# EasyEDA Pro project Foc驱动板.eprj, schematic Schematic1
Board Name: Board1; Create Date: 2026-01-11; Page Name: P1; Project Name: Foc驱动板; Schematic Name: Schematic1; Update Date: 2026-01-12; Company: 嘉立创EDA; Page Size: A4; Version: V1.0
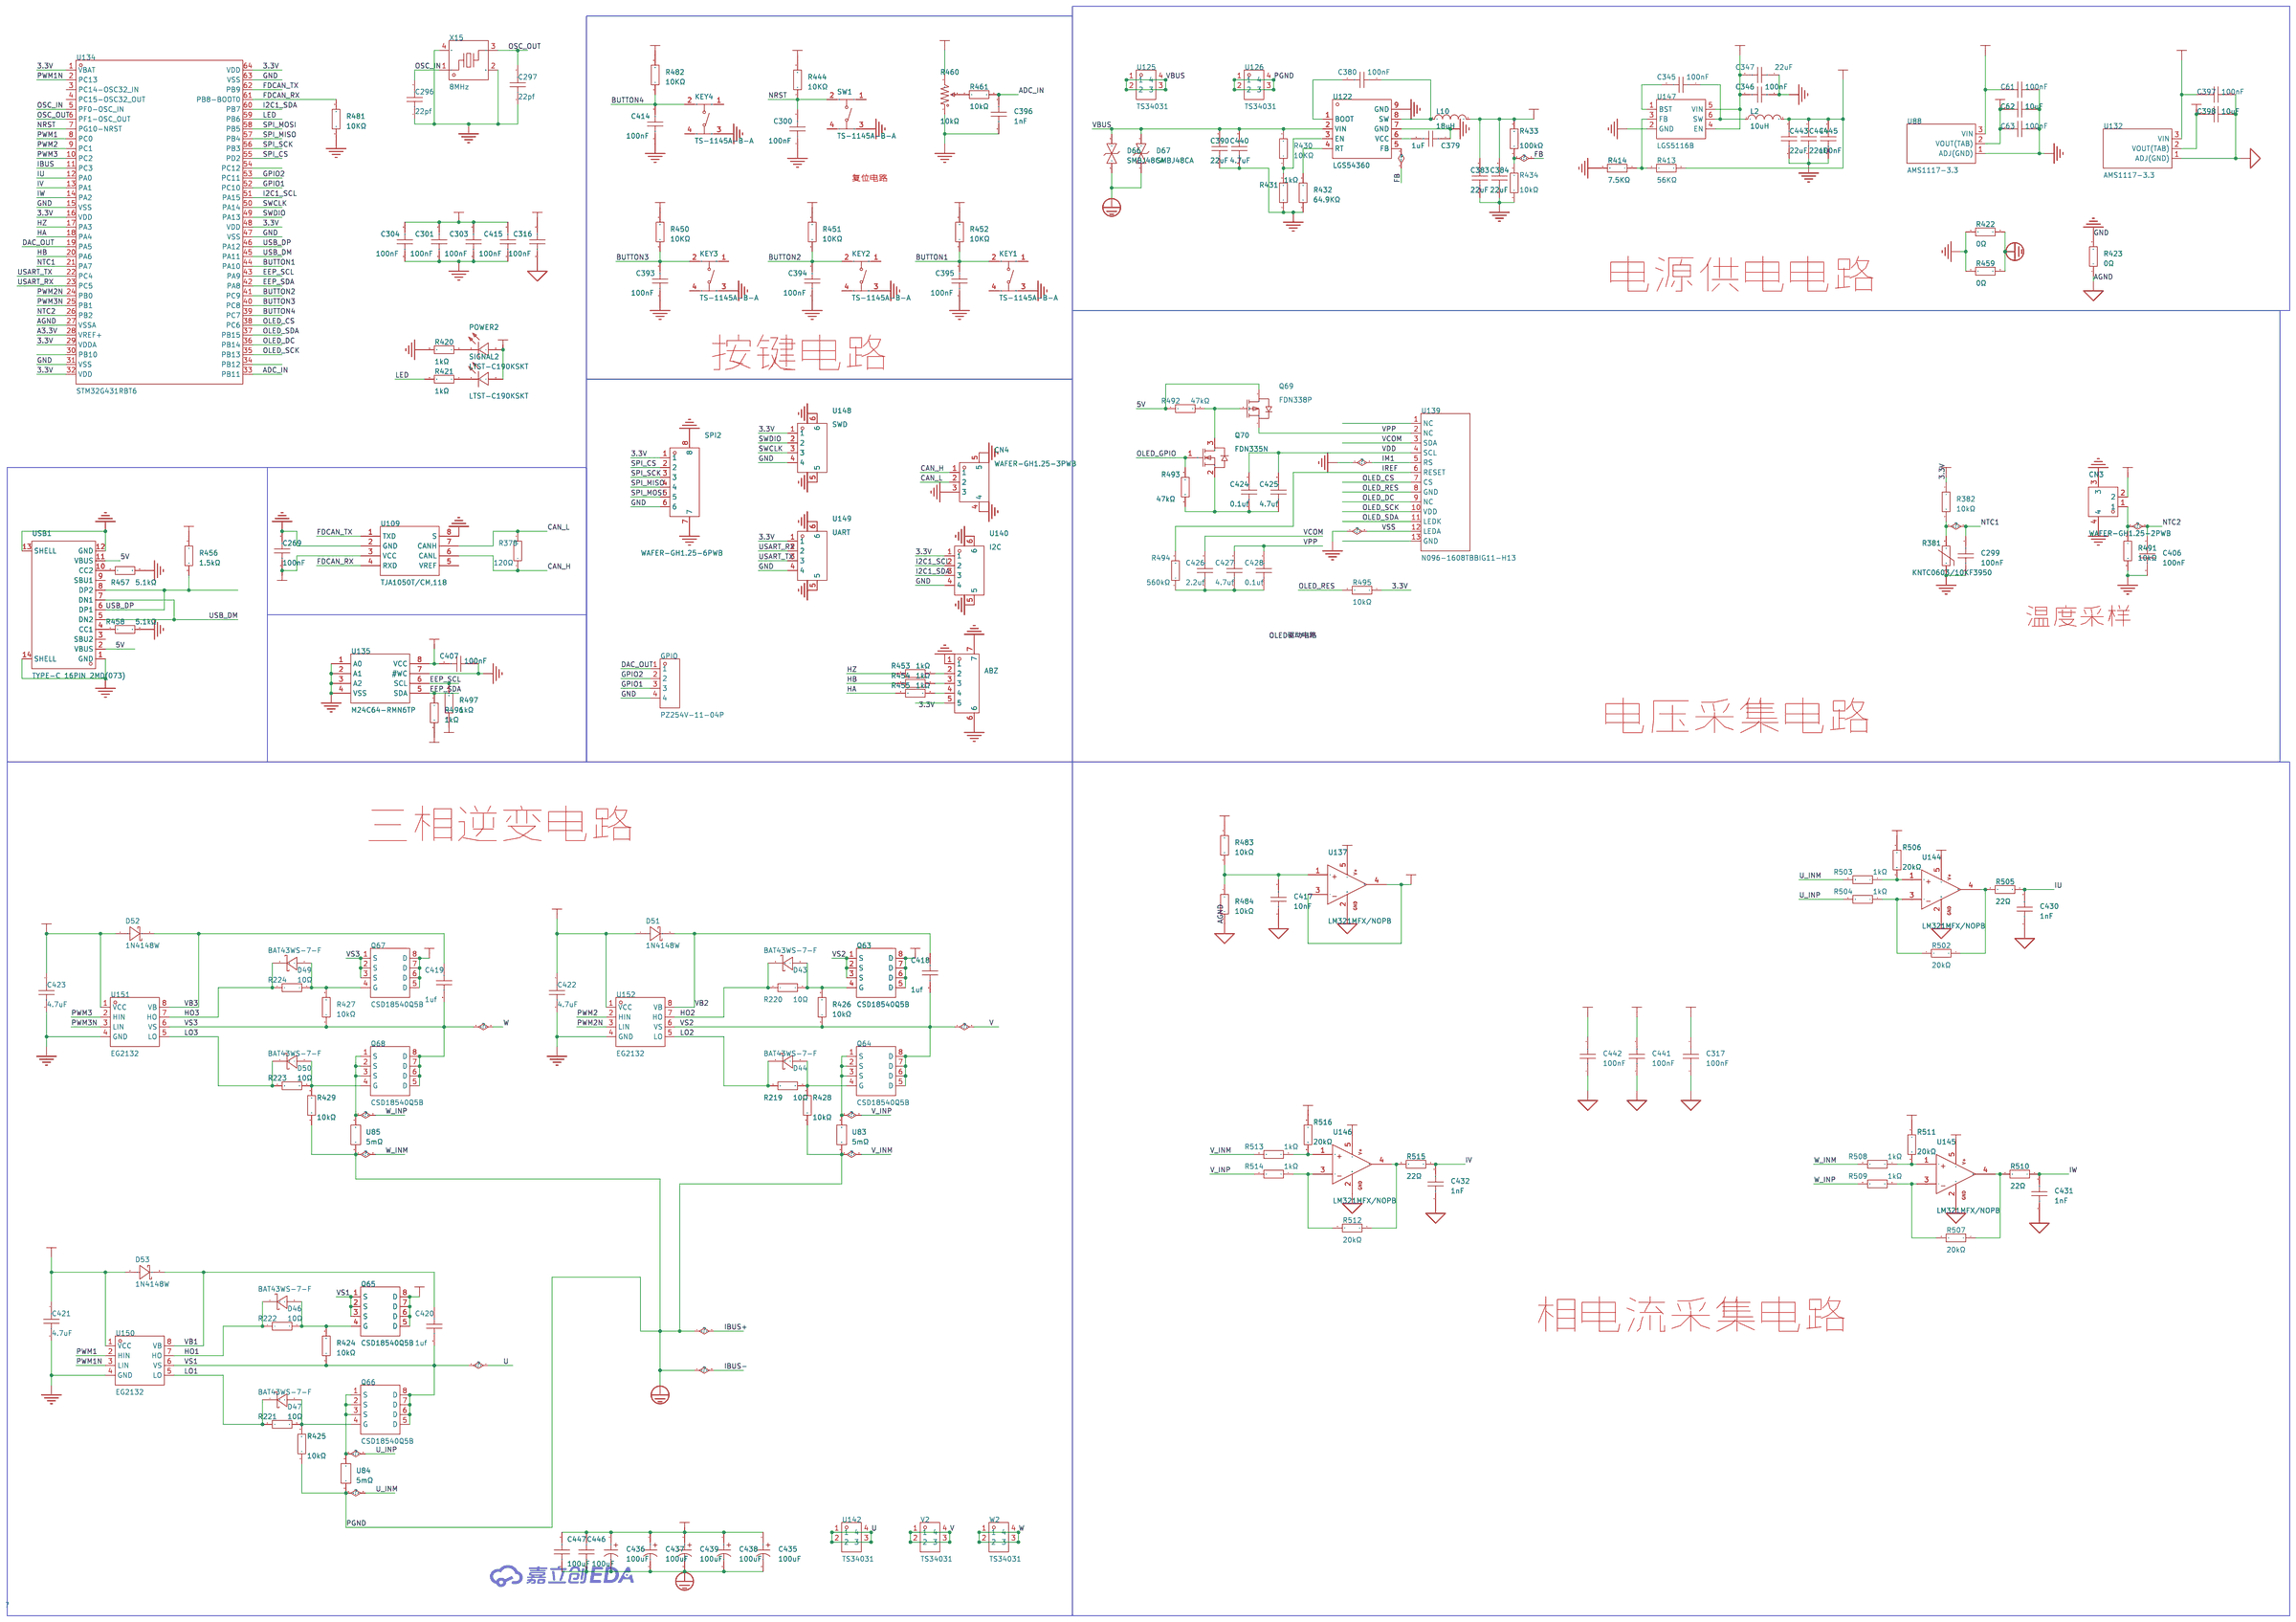
[diagram p0: schematic sheet]

## Parts
C61  100nF  [C0603]
C62  10uF  [C0603]
C63  100nF  [C0603]
C269  100nF  [C0603]
C296  22pf  [C0603]
C297  22pf  [C0603]
C299  100nF  [C0603]
C300  100nF  [C0603]
C301  100nF  [C0603]
C303  100nF  [C0603]
C304  100nF  [C0603]
C316  100nF  [C0603]
C317  100nF  [C0603]
C345  100nF  [C0603]
C346  100nF  [C0603]
C347  22uF  [C0603]
C379  1uF  [C0603]
C380  100nF  [C0603]
C383  22uF  [C0805]
C384  22uF  [C0805]
C390  22uF  [C0805]
C393  100nF  [C0603]
C394  100nF  [C0603]
C395  100nF  [C0603]
C396  1nF  [C0603]
C397  100nF  [C0603]
C398  10uF  [C0603]
C406  100nF  [C0603]
C407  100nF  [C0603]
C414  100nF  [C0603]
C415  100nF  [C0603]
C417  10nF  [C0603]
C418  1uf  [C0603]
C419  1uf  [C0603]
C420  1uf  [C0603]
C421  4.7uF  [C0603]
C422  4.7uF  [C0603]
C423  4.7uF  [C0603]
C424  0.1uf  [C0603]
C425  4.7uf  [C0603]
C426  2.2uf  [C0603]
C427  4.7uf  [C0603]
C428  0.1uf  [C0603]
C430  1nF  [C0603]
C431  1nF  [C0603]
C432  1nF  [C0603]
C435  100uF  [CAP-TH_BD8.0-P3.50-D0.5-FD]
C436  100uF  [CAP-TH_BD8.0-P3.50-D0.5-FD]
C437  100uF  [CAP-TH_BD8.0-P3.50-D0.5-FD]
C438  100uF  [CAP-TH_BD8.0-P3.50-D0.5-FD]
C439  100uF  [CAP-TH_BD8.0-P3.50-D0.5-FD]
C440  4.7uF  [C0805]
C441  100nF  [C0603]
C442  100nF  [C0603]
C443  22uF  [C0603]
C444  22uF  [C0603]
C445  100nF  [C0603]
C446  100uF  [C1210]
C447  100uF  [C1210]
CN3  WAFER-GH1.25-2PWB  [CONN-TH_2P-P1.25_XUNPU_WAFER-GH1.25-2PWB]
CN4  WAFER-GH1.25-3PWB  [CONN-TH_3P-P1.25_GH1.25]
D43  BAT43WS-7-F  [SOD-323_L1.8-W1.3-LS2.5-RD]
D44  BAT43WS-7-F  [SOD-323_L1.8-W1.3-LS2.5-RD]
D46  BAT43WS-7-F  [SOD-323_L1.8-W1.3-LS2.5-RD]
D47  BAT43WS-7-F  [SOD-323_L1.8-W1.3-LS2.5-RD]
D49  BAT43WS-7-F  [SOD-323_L1.8-W1.3-LS2.5-RD]
D50  BAT43WS-7-F  [SOD-323_L1.8-W1.3-LS2.5-RD]
D51  1N4148W  [SOD-123_L2.7-W1.6-LS3.7-FD]
D52  1N4148W  [SOD-123_L2.7-W1.6-LS3.7-FD]
D53  1N4148W  [SOD-123_L2.7-W1.6-LS3.7-FD]
D66  SMBJ48CA  [SMB_L4.6-W3.6-LS5.4-BI]
D67  SMBJ48CA  [SMB_L4.6-W3.6-LS5.4-BI]
GPIO  PZ254V-11-04P  [HDR-TH_4P-P2.54-V-M]
HALL2  ABZ  [CONN-SMD_5P-P1.25_XUNPU_WAFER-GH1.25-5PWB]
KEY1  TS-1145A-B-A  [SW-SMD_4P-L4.2-W3.2-P2.15-LS5.2]
KEY2  TS-1145A-B-A  [SW-SMD_4P-L4.2-W3.2-P2.15-LS5.2]
KEY3  TS-1145A-B-A  [SW-SMD_4P-L4.2-W3.2-P2.15-LS5.2]
KEY4  TS-1145A-B-A  [SW-SMD_4P-L4.2-W3.2-P2.15-LS5.2]
L2  10uH  [IND-SMD_L5.4-W5.2_FXL0530]
L10  18uH  [IND-SMD_L6.0-W6.0]
POWER2  LTST-C190KSKT  [LED0603-RD]
Q63  CSD18540Q5B  [VSON-CLIP-8_L5.0-W6.0-P1.27-BL]
Q64  CSD18540Q5B  [VSON-CLIP-8_L5.0-W6.0-P1.27-BL]
Q65  CSD18540Q5B  [VSON-CLIP-8_L5.0-W6.0-P1.27-BL]
Q66  CSD18540Q5B  [VSON-CLIP-8_L5.0-W6.0-P1.27-BL]
Q67  CSD18540Q5B  [VSON-CLIP-8_L5.0-W6.0-P1.27-BL]
Q68  CSD18540Q5B  [VSON-CLIP-8_L5.0-W6.0-P1.27-BL]
Q69  FDN338P  [SOT-23-3_L2.9-W1.3-P1.90-LS2.4-BR]
Q70  FDN335N  [SOT-23-3_L3.0-W1.7-P0.95-LS2.9-BR]
R219  10Ω  [R0603]
R220  10Ω  [R0603]
R221  10Ω  [R0603]
R222  10Ω  [R0603]
R223  10Ω  [R0603]
R224  10Ω  [R0603]
R378  120Ω  [R0603]
R381  KNTC0603/10KF3950  [R0603]
R382  10kΩ  [R0603]
R413  56KΩ  [R0603]
R414  7.5KΩ  [R0603]
R420  1kΩ  [R0603]
R421  1kΩ  [R0603]
R422  0Ω  [R0805]
R423  0Ω  [R0805]
R424  10kΩ  [R0603]
R425  10kΩ  [R0603]
R426  10kΩ  [R0603]
R427  10kΩ  [R0603]
R428  10kΩ  [R0603]
R429  10kΩ  [R0603]
R430  10KΩ  [R0603]
R431  1kΩ  [R0603]
R432  64.9KΩ  [R0603]
R433  100kΩ  [R0603]
R434  10kΩ  [R0603]
R444  10KΩ  [R0603]
R450  10KΩ  [R0603]
R451  10KΩ  [R0603]
R452  10KΩ  [R0603]
R453  1kΩ  [R0603]
R454  1kΩ  [R0603]
R455  1kΩ  [R0603]
R456  1.5kΩ  [R0603]
R457  5.1kΩ  [R0603]
R458  5.1kΩ  [R0603]
R459  0Ω  [R0805]
R460  10kΩ  [RES-ADJ-TH_3P-L9.5-W9.5-P2.54-BR-BS]
R461  10kΩ  [R0603]
R481  10KΩ  [R0603]
R482  10KΩ  [R0603]
R483  10kΩ  [R0603]
R484  10kΩ  [R0603]
R491  10kΩ  [R0603]
R492  47kΩ  [R0603]
R493  47kΩ  [R0603]
R494  560kΩ  [R0603]
R495  10kΩ  [R0603]
R496  1kΩ  [R0603]
R497  1kΩ  [R0603]
R502  20kΩ  [R0603]
R503  1kΩ  [R0603]
R504  1kΩ  [R0603]
R505  22Ω  [R0603]
R506  20kΩ  [R0603]
R507  20kΩ  [R0603]
R508  1kΩ  [R0603]
R509  1kΩ  [R0603]
R510  22Ω  [R0603]
R511  20kΩ  [R0603]
R512  20kΩ  [R0603]
R513  1kΩ  [R0603]
R514  1kΩ  [R0603]
R515  22Ω  [R0603]
R516  20kΩ  [R0603]
SIGNAL2  LTST-C190KSKT  [LED0603-RD]
SPI2  WAFER-GH1.25-6PWB  [CONN-SMD_6P-P1.25_XUNPU_WAFER-GH1.25-6PWB]
SW1  TS-1145A-B-A  [SW-SMD_4P-L4.2-W3.2-P2.15-LS5.2]
U83  5mΩ  [R2512]
U84  5mΩ  [R2512]
U85  5mΩ  [R2512]
U88  AMS1117-3.3  [SOT-89_L4.5-W2.5-P1.50-LS4.2-BR]
U109  TJA1050T/CM,118  [SOIC-8_L5.0-W4.0-P1.27-LS6.0-BL]
U122  LGS54360  [ESOP-8_L4.9-W3.9-P1.27-LS6.0-BL-EP]
U125  TS34031  [CONN-SMD_TS34031]
U126  TS34031  [CONN-SMD_TS34031]
U132  AMS1117-3.3  [SOT-89_L4.5-W2.5-P1.50-LS4.2-BR]
U134  STM32G431RBT6  [LQFP-64_L10.0-W10.0-P0.50-LS12.0-BL]
U135  M24C64-RMN6TP  [SOIC-8_L5.0-W4.0-P1.27-LS6.0-BL]
U137  LM321MFX/NOPB  [SOT-23-5_L3.0-W1.7-P0.95-LS2.8-BR]
U139  N096-1608TBBIG11-H13  [OLED-SMD_ST7735S]
U140  I2C  [CONN-SMD_4P-P1.25_XUNPU_WAFER-GH1.25-4PWB]
U142  TS34031  [CONN-SMD_TS34031]
U144  LM321MFX/NOPB  [SOT-23-5_L3.0-W1.7-P0.95-LS2.8-BR]
U145  LM321MFX/NOPB  [SOT-23-5_L3.0-W1.7-P0.95-LS2.8-BR]
U146  LM321MFX/NOPB  [SOT-23-5_L3.0-W1.7-P0.95-LS2.8-BR]
U147  LGS5116B  [SOT-23-6_L2.9-W1.6-P0.95-LS2.8-BR]
U148  SWD  [CONN-SMD_4P-P1.25_XUNPU_WAFER-GH1.25-4PWB]
U149  UART  [CONN-SMD_4P-P1.25_XUNPU_WAFER-GH1.25-4PWB]
U150  EG2132  [SOP-8_L4.9-W3.9-P1.27-LS6.0-BL]
U151  EG2132  [SOP-8_L4.9-W3.9-P1.27-LS6.0-BL]
U152  EG2132  [SOP-8_L4.9-W3.9-P1.27-LS6.0-BL]
USB1  TYPE-C 16PIN 2MD(073)  [USB-C-SMD_TYPE-C-6PIN-2MD-073]
V2  TS34031  [CONN-SMD_TS34031]
W2  TS34031  [CONN-SMD_TS34031]
X15  8MHz  [CRYSTAL-SMD_4P-L3.2-W2.5-BL]

## Library data of the parts
C61-C63 C299 C317 C396-C398 C406 C417-C428 C430-C432 C441 C442 = CGA0603X7R104K500JT: 容值:100nF;精度:±10%;额定电压:50V;材质(温度系数):X7R;; LCSC Part Name: 100nF ±10% 50V; Supplier Part: C6119867; Manufacturer: HRE(芯声); Supplier Footprint: 0603; JLCPCB Part Class: 扩展库; Supplier: LCSC; Tolerance: ±10%; Voltage Rated: 50V; Temperature Coefficient: X7R
C269 = CGA0603X5R226M160JT: 容值:22uF;精度:±20%;额定电压:16V;材质(温度系数):X5R;; LCSC Part Name: 22uF ±20% 16V; Supplier Part: C6119868; Manufacturer: HRE(芯声); Supplier Footprint: 0603; JLCPCB Part Class: 扩展库; Supplier: LCSC; Tolerance: ±20%; Voltage Rated: 16V; Temperature Coefficient: X5R
C296 C297 C300 C301 C303 C304 C316 C393-C395 C407 C414 C415 = CC0603KRX7R9BB104: 容值:100nF;精度:±10%;额定电压:50V;材质(温度系数):X7R;; LCSC Part Name: 100nF ±10% 50V; Supplier Part: C14663; Manufacturer: YAGEO(国巨); Supplier Footprint: 0603; JLCPCB Part Class: 基础库; Datasheet: https://atta.szlcsc.com/upload/public/pdf/source/20180910/C282072_33301C7F631E79921B82A8DAC6BCC5B3.pdf; Supplier: LCSC; Tolerance: ±10%; Voltage Rated: 50V; Temperature Coefficient: X7R
C345-C347 C379 C380 C443-C445 = CC0603KRX7R9BB474: 容值:470nF;精度:±10%;额定电压:50V;材质(温度系数):X7R;; LCSC Part Name: 470nF ±10% 50V; Supplier Part: C513577; Manufacturer: YAGEO(国巨); Supplier Footprint: 0603; JLCPCB Part Class: 扩展库; Datasheet: https://atta.szlcsc.com/upload/public/pdf/source/20200423/C519417_FF9998E3F66D767819CD86A66B468321.pdf; Supplier: LCSC; Tolerance: ±10%; Voltage Rated: 50V; Temperature Coefficient: X7R
C383 C384 C390 C440 = CGA0805X5R226M350MT: 容值:22uF;精度:±20%;额定电压:35V;材质(温度系数):X5R;; LCSC Part Name: 22uF ±20% 35V; Supplier Part: C6119901; Manufacturer: HRE(芯声); Supplier Footprint: 0805; JLCPCB Part Class: 扩展库; Datasheet: https://atta.szlcsc.com/upload/public/pdf/source/20231129/D589D0CC4D260F7AC3A77E53B455CCB3.pdf; Supplier: LCSC; Tolerance: ±20%; Voltage Rated: 35V; Temperature Coefficient: X5R
C435-C439 = ERG50V100M8X12: 容值:100uF;精度:±20%;额定电压:50V;纹波电流:680mA@100kHz;等效串联电阻(ESR):120mΩ@100kHz;; LCSC Part Name: 100uF ±20% 50V; Supplier Part: C47344183; Manufacturer: JIERR(捷而瑞); Supplier Footprint: 插件,D8xL12mm; JLCPCB Part Class: 扩展库; Datasheet: https://item.szlcsc.com/datasheet/ERG50V100M8X12/49556624.html; Supplier: LCSC; Tolerance: ±20%; Voltage Rating: 50V; Ripple Current: 680mA@100kHz; Equivalent Series Resistance(ESR): 120mΩ@100kHz; Pin Spacing: 3.5mm; Diameter: 8mm; Height - Seated (Max): 12mm; Lifetime: 2000hrs@105℃; Operating Temperature: -40℃~+105℃
C446 C447 = CL32B106KBJNNNE: LCSC Part Name: 10uF ±10% 50V; Supplier Part: C138687; Manufacturer: SAMSUNG(三星); Supplier Footprint: 1210; JLCPCB Part Class: 扩展库; Datasheet: https://item.szlcsc.com/datasheet/CL32B106KBJNNNE/150006.html; Supplier: LCSC; Tolerance: ±10%; Voltage Rating: 50V; Temperature Coefficient: X7R
CN3 = WAFER-GH1.25-2PWB: 插针结构:1x2P;间距:1.25mm;安装方式:卧贴;参考系列:GH;总PIN数:2P;排数:1;每排PIN数:2;行距:-;额定电流:1A;触头材质:黄铜;触头镀层:-;工作温度范围:-25℃~+85℃;; LCSC Part Name: 1x2P 间距:1.25mm 卧贴 系列:GH; Supplier Part: C3029377; Manufacturer: XUNPU(讯普); Supplier Footprint: SMD,P=1.25mm,卧贴; JLCPCB Part Class: 扩展库; Datasheet: https://atta.szlcsc.com/upload/public/pdf/source/20220527/CB8773BFB0913C3B8ABD62CB38BA101A.pdf; Supplier: LCSC; Pins Structure: 1x2P; Pitch: 1.25mm; Mounting Type: 卧贴; Reference Series: GH; Number of Pins: 2P; Number of Rows: 1; Number of PINs Per Row: 2; Current Rating: 1A; Contact Material: 黄铜; Operating Temperature: -25℃~+85℃; Voltage Rating: 125V; Plastic Material: LCP; Supplementary Features: 辅助焊脚; Color: 米色; Z-Height of the Board: 4.35mm; X-Length of Bottom Edge on Board (Spacing Line): 5.75mm; Y-Width of Bottom Edge on Board: 5mm
CN4 = WAFER-GH1.25-3PWB: LCSC Part Name: 1x3P 间距:1.25mm 卧贴 系列:GH; Supplier Part: C3029378; Manufacturer: XUNPU(讯普); Supplier Footprint: SMD,P=1.25mm,卧贴; JLCPCB Part Class: 扩展库; Datasheet: https://item.szlcsc.com/datasheet/WAFER-GH1.25-3PWB/3561390.html; Supplier: LCSC; Pins Structure: 1x3P; Pitch: 1.25mm; Mounting Type: 卧贴; Reference Series: GH; Number of Pins: 3P; Number of Rows: 1; Number of PINs Per Row: 3; Current Rating: 1A; Contact Material: 黄铜; Contact Plating: 锡; Operating Temperature: -25℃~+85℃; Voltage Rating: 125V; Plastic Material: LCP; Supplementary Features: 辅助焊脚; Color: 米色; Z-Height of the Board: 4.35mm; X-Length of Bottom Edge on Board (Spacing Line): 7mm; Y-Width of Bottom Edge on Board: 5mm
D43 D44 D46 D47 D49 D50 = BAT43WS-7-F: 正向压降(Vf):1V@0.2A;直流反向耐压(Vr):30V;整流电流:200mA;; LCSC Part Name: 电压:30V 电流:200mA; Supplier Part: C134399; Manufacturer: DIODES(美台); Supplier Footprint: SOD-323; JLCPCB Part Class: 扩展库; Datasheet: https://atta.szlcsc.com/upload/public/pdf/source/20171023/C134399_15087453364591052494.pdf; Supplier: LCSC; Forward Voltage (Vf@If): 1V@0.2A; Reverse Voltage (Vr): 30V; Rectified Current: 200mA; Reverse Leakage Current (Ir): 500nA@25V
D51-D53 = 1N4148W_C7420318: 二极管配置:独立式;正向压降(Vf):1.25V@150mA;直流反向耐压(Vr):100V;平均整流电流(Io):150mA;功率:400mW;反向恢复时间(trr):4ns;; LCSC Part Name: 电压:100V 电流:150mA; Supplier Part: C7420318; Manufacturer: 宏迦橙; Supplier Footprint: SOD-123; JLCPCB Part Class: 扩展库; Datasheet: https://atta.szlcsc.com/upload/public/pdf/source/20230828/E5C3F7A4272052930A7E03B75759BF50.pdf; Supplier: LCSC; Diode Configuration: 独立式; Forward Voltage (Vf@If): 1.25V@150mA; Reverse Voltage (Vr): 100V; Average Rectified Current (Io): 150mA; Power Dissipation: 400mW; Reverse Leakage Current: 1uA@75V; Reverse Recovery Time (trr): 4ns; Operating Temperature: -55℃~+150℃
D66 D67 = SMBJ48CA_C19077591: LCSC Part Name: 双向TVS 48V截止 峰值浪涌电流：7.75A@10/1000us; Supplier Part: C19077591; Manufacturer: R+O(宏嘉诚); Supplier Footprint: DO-214AA(SMB); JLCPCB Part Class: 扩展库; Datasheet: https://item.szlcsc.com/datasheet/SMBJ48CA/20275676.html; Supplier: LCSC; Polarity: 双向; Reverse Stand-Off Voltage (Vrwm): 48V; Clamping Voltage: 77.4V; Peak Pulse Current (Ipp): 7.75A@10/1000us; Peak Pulse Power Dissipation (Ppp): 600W@10/1000us; Voltage - Breakdown: 58.9V; Reverse Leakage Current (Ir): 5uA; Number of Channels: 单路; Operating Temperature: -55℃~+150℃; level of protection: IEC 61000-4-2; Type: TVS
GPIO = PZ254V-11-04P: 插针结构:1x4P;间距:2.54mm;行距:-;圆针/方针:方针;安装方式:直插;排数:单排;总PIN位数:4P;额定电流:3A;额定电压:250V;配合针长度:6mm;塑高:2.5mm;端接针长度:3mm;触头材质:-;工作温度:-40℃~+105℃;颜色:黑色;; LCSC Part Name: 1x4P 间距:2.54mm 方针 直插; Supplier Part: C2691448; Manufacturer: XFCN(兴飞); Supplier Footprint: 插件,P=2.54mm; JLCPCB Part Class: 扩展库; Datasheet: https://item.szlcsc.com/datasheet/PZ254V-11-04P/2801085.html; Supplier: LCSC; Pin Structure: 1x4P; Pitch: 2.54mm; Circluar Pins/Square Pins: 方针; Mounting Type: 直插; Number of Rows: 单排; Number of Pins: 4P; Current Rating: 3A; Voltage Rating (Max): 250V; Length of Mating Pin: 6mm; Insulation Height: 2.5mm; Length of End Connection Pin: 3mm; Operating Temperature: -40℃~+105℃; Color: 黑色
HALL2 = WAFER-GH1.25-5PWB: 插针结构:1x5P;间距:1.25mm;安装方式:卧贴;参考系列:GH;总PIN数:5P;排数:1;每排PIN数:5;行距:-;额定电流:1A;触头材质:黄铜;触头镀层:-;工作温度范围:-25℃~+85℃;; LCSC Part Name: 1x5P 间距:1.25mm 卧贴 系列:GH; Supplier Part: C3029380; Manufacturer: XUNPU(讯普); Supplier Footprint: SMD,P=1.25mm,卧贴; JLCPCB Part Class: 扩展库; Datasheet: https://atta.szlcsc.com/upload/public/pdf/source/20220527/CB8773BFB0913C3B8ABD62CB38BA101A.pdf; Supplier: LCSC; Pins Structure: 1x5P; Pitch: 1.25mm; Mounting Type: 卧贴; Reference Series: GH; Number of Pins: 5P; Number of Rows: 1; Number of PINs Per Row: 5; Current Rating: 1A; Contact Material: 黄铜; Operating Temperature: -25℃~+85℃; Voltage Rating: 125V; Plastic Material: LCP; Supplementary Features: 辅助焊脚; Color: 米色; Z-Height of the Board: 4.35mm; X-Length of Bottom Edge on Board (Spacing Line): 9.5mm; Y-Width of Bottom Edge on Board: 5mm
KEY1-KEY4 SW1 = TS-1145A-B-A: 电路结构:单刀单掷;按钮形状:椭圆形按钮;作用力:160gf;安装方式:立贴;开关长度:4.2mm;开关宽度:3.2mm;开关高度:2.5mm;带支架:不带;触点电流:50mA;额定电压(DC):12V;绝缘电阻:-;带灯:无;机械寿命:10万次;; LCSC Part Name: 4.2*3.2*2.5mm 立贴 轻触开关; Supplier Part: C318904; Manufacturer: XKB Connectivity(中国星坤); Supplier Footprint: SMD; JLCPCB Part Class: 扩展库; Datasheet: https://atta.szlcsc.com/upload/public/pdf/source/20211011/FC00869C3CE33BCCD344D072F551E76B.pdf; Supplier: LCSC; Circuit: 单刀单掷; Actuator Style: 椭圆形按钮; Operating Force: 160gf; Mounting Style: 立贴; Switch Length: 4.2mm; Switch Width: 3.2mm; Switch Height: 2.5mm; Strike Gundam: 不带; Contact Current: 50mA; Voltage Rating (DC): 12V; Actuator/Cap Color: 白色; With Lamp: 无; Mechanical Life: 10万次; Operating Temperature: -30℃~+85℃
L2 = FXL0530-100-M: 电感值:10uH;精度:±20%;额定电流:3.2A;饱和电流(Isat):3.5A;类型:一体成型电感;; LCSC Part Name: 10uH ±20% 3.5A; Supplier Part: C177248; Manufacturer: cjiang(长江微电); Supplier Footprint: SMD,5.2x5.4mm; JLCPCB Part Class: 扩展库; Datasheet: https://atta.szlcsc.com/upload/public/pdf/source/20240426/3189EA8206330E2108542F9E34E540E7.pdf; Supplier: LCSC; Tolerance: ±20%; Rated Current: 3.2A; Saturation Current (Isat): 3.5A; DC Resistance (DCR): 125mΩ; Type: 一体成型电感
L10 = SMNR6045-180MT: 电感值:18uH;精度:±20%;额定电流:-;饱和电流(Isat):2.3A;类型:磁胶屏蔽电感;; LCSC Part Name: 18uH ±20% 2.3A; Supplier Part: C467143; Manufacturer: SXN(顺翔诺); Supplier Footprint: SMD,6x6mm; JLCPCB Part Class: 扩展库; Datasheet: https://atta.szlcsc.com/upload/public/pdf/source/20210810/8C07D4BA256EC9B57FF3FBBF0FDAC34D.pdf; Supplier: LCSC; Tolerance: ±20%; Current - Saturation(Isat): 2.3A; DC Resistance(DCR): 106mΩ; Type: 磁胶屏蔽电感
POWER2 SIGNAL2 = LTST-C190KSKT: 发光颜色:黄色;正向电压(VF):2.1V;功率:75mW;正向电流:20mA;主波长:584.5nm~597nm;二极管配置:-;透镜颜色:无色透明透镜;色温:-;发光强度:104mcd;发光角度:130°;载带方式:-;工作温度:-30℃~+85℃;; LCSC Part Name: 黄灯; Supplier Part: C125095; Manufacturer: LITEON(光宝); Supplier Footprint: 0603; JLCPCB Part Class: Extended Part; Datasheet: https://atta.szlcsc.com/upload/public/pdf/source/20180129/C125095_15171881843821315881.pdf; Supplier: LCSC; Emitted Color: 黄色; Forward Voltage (VF): 2.1V; Power Dissipation: 75mW; Forward Current: 20mA; Dominant Wavelength: 584.5nm~597nm; Peak Wavelength: 588nm; Lens Color: 无色透明透镜; Luminous Intensity: 104mcd; Viewing Angle: 130°; Operating Temperature: -30℃~+85℃
Q63-Q68 = CSD18540Q5B: 类型:1个N沟道;漏源电压(Vdss):60V;连续漏极电流(Id):205A;导通电阻(RDS(on)@Vgs,Id):2.6mΩ@10V,28A;功率(Pd):3.8W;阈值电压(Vgs(th)@Id):1.9V@250uA;; LCSC Part Name: 1个N沟道 耐压:60V 电流:205A; Supplier Part: C86513; Manufacturer: TI(德州仪器); Supplier Footprint: VSON-8(5x6); JLCPCB Part Class: 扩展库; Datasheet: https://www.ti.com/lit/ds/symlink/csd18540q5b.pdf?ts=1718590350466&amp;ref_url=https%253A%252F%252Fwww.ti.com.cn%252Fproduct%252Fzh-cn%252FCSD18540Q5B%253FkeyMatch%253DCSD18540Q5B%2526tisearch%253Dsearch-everything%2526usecase%253DOPN; Supplier: LCSC; Type: 1个N沟道; Drain Source Voltage (Vdss): 60V; Continuous Drain Current (Id): 205A; Drain Source On Resistance (RDS(on)@Vgs,Id): 2.6mΩ@10V,28A; Power Dissipation (Pd): 3.8W; Gate Threshold Voltage (Vgs(th)@Id): 1.9V@250uA; Total Gate Charge (Qg@Vgs): 41nC@10V; Input Capacitance (Ciss@Vds): 4.23nF@30V; Reverse Transfer Capacitance (Crss@Vds): 20pF@30V; Operating Temperature: -55℃~+175℃
Q69 = FDN338P: 漏源电压(Vdss):20V;连续漏极电流(Id):1.6A;导通电阻(RDS(on)@Vgs,Id):115mΩ@4.5V,1.6A;功率(Pd):1.1W;阈值电压(Vgs(th)@Id):400mV@250uA;; LCSC Part Name: 耐压:20V 电流:1.6A; Supplier Part: C2890130; Manufacturer: TECH PUBLIC(台舟); Supplier Footprint: SOT-23; JLCPCB Part Class: 扩展库; Datasheet: https://atta.szlcsc.com/upload/public/pdf/source/20210903/7E6CB84F0F80073F6978D1021964D836.pdf; Supplier: LCSC; Drain Source Voltage (Vdss): 20V; Continuous Drain Current (Id): 1.6A; Drain Source On Resistance (RDS(on)@Vgs,Id): 115mΩ@4.5V,1.6A; Power Dissipation (Pd): 1.1W; Gate Threshold Voltage (Vgs(th)@Id): 400mV@250uA; Total Gate Charge (Qg@Vgs): 60nC@4.5V; Input Capacitance (Ciss@Vds): 405pF@10V; Reverse Transfer Capacitance (Crss@Vds): 45pF; Operating Temperature: -55℃~+150℃
Q70 = FDN335N: 类型:1个N沟道;漏源电压(Vdss):20V;连续漏极电流(Id):1.7A;导通电阻(RDS(on)@Vgs,Id):70mΩ@4.5V,1.7A;功率(Pd):500mW;阈值电压(Vgs(th)@Id):1.5V@250uA;; LCSC Part Name: 1个N沟道 耐压:20V 电流:1.7A; Supplier Part: C241804; Manufacturer: onsemi(安森美); Supplier Footprint: SOT-23-3; JLCPCB Part Class: 扩展库; Datasheet: https://atta.szlcsc.com/upload/public/pdf/source/20181106/C241804_FB6C2909C796B85F26DD1FA55F5B521F.pdf; Supplier: LCSC; Type: 1个N沟道; Drain Source Voltage (Vdss): 20V; Continuous Drain Current (Id): 1.7A; Drain Source On Resistance (RDS(on)@Vgs,Id): 70mΩ@4.5V,1.7A; Power Dissipation (Pd): 500mW; Gate Threshold Voltage (Vgs(th)@Id): 1.5V@250uA; Total Gate Charge (Qg@Vgs): 3.5nC; Input Capacitance (Ciss@Vds): 310pF@10V; Reverse Transfer Capacitance (Crss@Vds): 40pF; Operating Temperature: -55℃~+150℃
R219-R224 R378 R413 R414 R420 R421 R424-R434 R444 R450-R458 R481 R482 R492-R497 = 0603WAF1000T5E: 电阻类型:厚膜电阻;阻值:100Ω;精度:±1%;功率:100mW;最大工作电压:75V;温度系数:±200ppm/℃;; LCSC Part Name: 100Ω ±1% 100mW 厚膜电阻; Supplier Part: C22775; Manufacturer: UNI-ROYAL(厚声); Supplier Footprint: 0603; JLCPCB Part Class: 基础库; Datasheet: https://atta.szlcsc.com/upload/public/pdf/source/20200306/C422600_1E6D84923E4A46A82E41ADD87F860B5C.pdf; Supplier: LCSC; Type: 厚膜电阻; Tolerance: ±1%; Power(Watts): 100mW; Overload Voltage (Max): 75V; Temperature Coefficient: ±200ppm/℃; Operating Temperature Range: -55℃~+155℃
R381 = KNTC0603/10KF3950: 阻值:10kΩ;B值(25℃/50℃):3950K;功率:100mW;B值精度:±1%;最大稳态电流(25℃):310uA;; Supplier Part: C2892547; Manufacturer: KUU; Supplier Footprint: 0603; JLCPCB Part Class: 扩展库; Datasheet: https://atta.szlcsc.com/upload/public/pdf/source/20210908/154E92DD1F52D9B3804AA862EC2D5FAB.pdf; Supplier: LCSC; Resistance @ 25℃: 10kΩ; B Constant (25℃/50℃): 3950K; B Constant (25℃/85℃): 3987K; Power(Watts): 100mW; B Constant Tolerance: ±1%; Steady State Current (Max): 310uA; Operating Temperature: -40℃~+125℃
R382 R461 R483 R484 R491 R502-R516 = 0603WAF1002T5E: 电阻类型:厚膜电阻;阻值:10kΩ;精度:±1%;功率:100mW;最大工作电压:75V;温度系数:±100ppm/℃;; LCSC Part Name: 厚膜电阻 10kΩ ±1% 100mW; Supplier Part: C25804; Manufacturer: UNI-ROYAL(厚声); Supplier Footprint: 0603; JLCPCB Part Class: 基础库; Datasheet: https://atta.szlcsc.com/upload/public/pdf/source/20200306/C422600_1E6D84923E4A46A82E41ADD87F860B5C.pdf; Supplier: LCSC; Type: 厚膜电阻; Tolerance: ±1%; Power(Watts): 100mW; Overload Voltage (Max): 75V; Temperature Coefficient: ±100ppm/℃; Operating Temperature Range: -55℃~+155℃
R422 R423 R459 = 0805W8F0000T5E: 电阻类型:厚膜电阻;阻值:0Ω;精度:±1%;功率:125mW;最大工作电压:150V;温度系数:±800ppm/℃;; LCSC Part Name: 0Ω ±1% 125mW 厚膜电阻; Supplier Part: C17477; Manufacturer: UNI-ROYAL(厚声); Supplier Footprint: 0805; JLCPCB Part Class: 基础库; Datasheet: https://atta.szlcsc.com/upload/public/pdf/source/20200306/C422600_1E6D84923E4A46A82E41ADD87F860B5C.pdf; Supplier: LCSC; Type: 厚膜电阻; Tolerance: ±1%; Power(Watts): 125mW; Overload Voltage (Max): 150V; Temperature Coefficient: ±800ppm/℃; Operating Temperature Range: -55℃~+155℃
R460 = 3386P-1-102TLF: 阻值:1kΩ;精度:±10%;; LCSC Part Name: 1kΩ ±10%; Supplier Part: C116301; Manufacturer: BOURNS; Supplier Footprint: 插件-3P,9.5x9.5mm; JLCPCB Part Class: 扩展库; Datasheet: https://item.szlcsc.com/datasheet/3386P-1-102TLF/117554.html; Supplier: LCSC; Tolerance: ±10%
SPI2 = WAFER-GH1.25-6PWB: 插针结构:1x6P;间距:1.25mm;安装方式:卧贴;参考系列:GH;总PIN数:6P;排数:1;每排PIN数:6;行距:-;额定电流:1A;触头材质:黄铜;触头镀层:-;工作温度范围:-25℃~+85℃;; LCSC Part Name: 1x6P 间距:1.25mm 卧贴 系列:GH; Supplier Part: C3029381; Manufacturer: XUNPU(讯普); Supplier Footprint: SMD,P=1.25mm,卧贴; JLCPCB Part Class: 扩展库; Datasheet: https://atta.szlcsc.com/upload/public/pdf/source/20220527/CB8773BFB0913C3B8ABD62CB38BA101A.pdf; Supplier: LCSC; Pins Structure: 1x6P; Pitch: 1.25mm; Mounting Type: 卧贴; Reference Series: GH; Number of Pins: 6P; Number of Rows: 1; Number of PINs Per Row: 6; Current Rating: 1A; Contact Material: 黄铜; Operating Temperature: -25℃~+85℃; Voltage Rating: 125V; Plastic Material: LCP; Supplementary Features: 辅助焊脚; Color: 米色; Z-Height of the Board: 4.35mm; X-Length of Bottom Edge on Board (Spacing Line): 10.75mm; Y-Width of Bottom Edge on Board: 5mm
U83-U85 = EBWM2512FL500S9: 电阻类型:采样电阻;阻值:0.5mΩ;精度:±1%;功率:6W;温度系数:±200ppm/℃;安装方式:贴片;; LCSC Part Name: 0.5mΩ ±1% 6W; Supplier Part: C7178835; Manufacturer: RESI(开步睿思）; Supplier Footprint: 2512; JLCPCB Part Class: 扩展库; Datasheet: https://atta.szlcsc.com/upload/public/pdf/source/20231123/32E1A2B1C6B1C8175FF8915A40EC1366.pdf; Supplier: LCSC; Type: 采样电阻; Tolerance: ±1%; Power(Watts): 6W; Temperature Coefficient: ±200ppm/℃; Mounting Sytle: 贴片
U88 U132 = AMS1117-3.3_C347256: 输出类型:固定;工作电压:18V;输出电压:3.3V;输出电流:1A;电源纹波抑制比(PSRR):60dB@(120Hz);输出极性:正极;; LCSC Part Name: 输出:3.3V 电流:1A 耐压:18V; Supplier Part: C347256; Manufacturer: UMW(友台半导体); Supplier Footprint: SOT-89; JLCPCB Part Class: 扩展库; Datasheet: https://atta.szlcsc.com/upload/public/pdf/source/20241218/BAF0263FA2E44BCD8AF41AA4FA04EFAA.pdf; Supplier: LCSC; Output Type: 固定; Voltage - Supply: 18V; Output Voltage: 3.3V; Output Current: 1A; Power Supply Rejection Ratio (PSRR): 60dB@(120Hz); Voltage Dropout: 1.3V@(1A); Features: 过流保护; Output Configuration: 正极; Number of Outputs: 1
U109 = TJA1050T/CM,118: 类型:-;; LCSC Part Name: 4.75V~5.25V; Supplier Part: C6952; Manufacturer: NXP(恩智浦); Supplier Footprint: SOP-8; JLCPCB Part Class: 扩展库; Datasheet: https://www.nxp.com/docs/en/data-sheet/TJA1050.pdf; Supplier: LCSC; Supply Voltage: 4.75V~5.25V; Supply Current: 50mA
U122 = LGS54360: 功能类型:降压型;输出类型:可调;工作电压:4.2V~65V;输出电流:3A;; LCSC Part Name: 4.2V-65V输入、3A宽输出范围、低纹波的同步降压转换器; Supplier Part: C20618070; Manufacturer: Legend-Si(棱晶半导体); Supplier Footprint: ESOP-8; JLCPCB Part Class: 扩展库; Datasheet: https://atta.szlcsc.com/upload/public/pdf/source/20240202/06A4A9AFD4E8DCA649D728EB1502243D.pdf; Supplier: LCSC; Function: 降压型; Output Type: 可调; Input Voltage: 4.2V~65V; Output Current: 3A; Switching Frequency: 200kHz~2MHz; Operating Temperature: -40℃~+125℃; Synchronous Rectification: 是; Number of Outputs: 1; Topology: 降压式; Quiescent Current (Iq): 70uA; Switch tube (built-in/external): 内置
U125 U126 U142 V2 W2 = TS34031: LCSC Part Name: 四脚 M3 二件套 TS34031; Supplier Part: C481441; Manufacturer: XFCN(兴飞); Supplier Footprint: SMD; JLCPCB Part Class: 扩展库; Datasheet: https://atta.szlcsc.com/upload/public/pdf/source/20240702/F73D6C2A31E01780573F167639CEBCF1.pdf; Supplier: LCSC
U134 = STM32G431RBT6: CPU内核:ARM-M系列;CPU最大主频:170MHz;应用领域:-;; LCSC Part Name: 带DSP和FPU的170MHz主流ARM Cortex-M4 MCU，具有128 KB Flash存储器、数学加速器和中等模拟电平集成; Supplier Part: C431633; Manufacturer: ST(意法半导体); Supplier Footprint: LQFP-64(10x10); JLCPCB Part Class: 扩展库; Datasheet: https://item.szlcsc.com/datasheet/STM32G431RBT6/428111.html; Supplier: LCSC; CPU Core: ARM-M系列; CPU Maximum Speed: 170MHz; Program Storage Size: 128KB; Number of I/O: 52; ADC (Bit): 12bit; DAC (Bit): 12bit; Voltage - Supply: 1.71V~3.6V
U135 = M24C64-RMN6TP: 接口类型:I2C;存储容量:64Kbit;时钟频率(fc):1MHz;; LCSC Part Name: 64 Kbit串行I2C总线EEPROM; Supplier Part: C79988; Manufacturer: ST(意法半导体); Supplier Footprint: SOIC-8; JLCPCB Part Class: 扩展库; Datasheet: https://item.szlcsc.com/datasheet/M24C64-RMN6TP/81133.html; Supplier: LCSC; Interface: I2C; Memory Size: 64Kbit; Clock Frequency: 1MHz; Voltage - Supply: 1.8V~5.5V; Write Cycle Time(Tw): 5ms; Data Retention - TDR (Year): 200年; Write Cycle Endurance: 400万次; Operating Temperature: -40℃~+85℃
U137 U144-U146 = LM321MFX/NOPB: 放大器数:单路;轨到轨:-;增益带宽积(GBP):-;输入失调电压(Vos):7mV;压摆率(SR):400V/ms;输入偏置电流(Ib):500nA;; Supplier Part: C9405; Manufacturer: TI(德州仪器); Supplier Footprint: SOT-23-5; JLCPCB Part Class: 扩展库; Datasheet: http://www.ti.com/cn/lit/gpn/lm321; Supplier: LCSC; Number of Channels: 单路; Maximum Power Supply Range (Vdd-Vss): 32V; Vos - Input Offset Voltage: 7mV; Slew Rate: 400V/ms; Ib - Input Bias Current: 500nA; Noise density(eN): 40nV/√Hz@1kHz; Common Mode Rejection Ratio(CMRR): 85dB; Operating Temperature: -40℃~+85℃; Single supply: 3V~30V
U139 = N096-1608TBBIG11-H13: 核心芯片:ST7735S;尺寸(inch):0.96;; LCSC Part Name: 0.96寸 13PIN TFT显示模块; Supplier Part: C2890616; Manufacturer: Wisevision(新智景); JLCPCB Part Class: 扩展库; Datasheet: https://item.szlcsc.com/datasheet/N096-1608TBBIG11-H13/3115564.html; Supplier: LCSC; Controller Type: ST7735S; Size: 0.96
U140 U148 U149 = WAFER-GH1.25-4PWB: 插针结构:1x4P;间距:1.25mm;安装方式:卧贴;参考系列:GH;总PIN数:4P;排数:1;每排PIN数:4;行距:-;额定电流:1A;触头材质:黄铜;触头镀层:-;工作温度范围:-25℃~+85℃;; LCSC Part Name: 1x4P 间距:1.25mm 卧贴 系列:GH; Supplier Part: C3029379; Manufacturer: XUNPU(讯普); Supplier Footprint: SMD,P=1.25mm,卧贴; JLCPCB Part Class: 扩展库; Datasheet: https://atta.szlcsc.com/upload/public/pdf/source/20220527/CB8773BFB0913C3B8ABD62CB38BA101A.pdf; Supplier: LCSC; Pins Structure: 1x4P; Pitch: 1.25mm; Mounting Type: 卧贴; Reference Series: GH; Number of Pins: 4P; Number of Rows: 1; Number of PINs Per Row: 4; Current Rating: 1A; Contact Material: 黄铜; Operating Temperature: -25℃~+85℃; Voltage Rating: 125V; Plastic Material: LCP; Supplementary Features: 辅助焊脚; Color: 米色; Z-Height of the Board: 4.35mm; X-Length of Bottom Edge on Board (Spacing Line): 8.25mm; Y-Width of Bottom Edge on Board: 5mm
U147 = LGS5116B: 功能类型:降压型;输出类型:可调;工作电压:4.5V~18V;输出电压:600mV~12V;输出电流:2A;; LCSC Part Name: 18V2A高效同步降压转换器; Supplier Part: C5818961; Manufacturer: Legend-Si(棱晶半导体); Supplier Footprint: SOT23-6; JLCPCB Part Class: 扩展库; Datasheet: https://atta.szlcsc.com/upload/public/pdf/source/20230512/E333B4D1849F2BD1668D55CA883123F4.pdf; Supplier: LCSC; Function: 降压型; Output Type: 可调; Voltage - Supply: 4.5V~18V; Output Voltage: 600mV~12V; Output Current: 2A; Frequency - Switching: 500kHz; Operating Temperature: -40℃~+125℃; Synchronous Rectifier: 是; Number of Outputs: 1; Topology: 降压式; Quiescent Current: 400uA; Switch tube (built-in/external): 内置
U150-U152 = EG2132: LCSC Part Name: 大功率MOS管、IGBT管栅极驱动芯片; Supplier Part: C480660; Manufacturer: EG(屹晶微); Supplier Footprint: SOP-8; JLCPCB Part Class: 扩展库; Datasheet: https://item.szlcsc.com/datasheet/EG2132/488583.html; Supplier: LCSC; Driven Configuration: 低边；高边; Load Type: MOSFET；IGBT; Number of Drivers: 2; Current - Output Low(IOL): 1.5A; Current - Output High(IOH): 1A; Voltage - Supply: 8V~20V; Rise Time: 180ns; Fall Time: 70ns; Features: 欠压保护(UVP); Operating Temperature: -45℃~+125℃; Input Logic Level - Low: -300mV~1V; Quiescent Current(Iq): 100uA
USB1 = TYPE-C 16PIN 2MD(073): 连接器类型:Type-C;协议标准:USB 3.1;公母:母;安装方式:卧贴;触点数量:16P;端口数量:1;额定电流 - 电源:3A;工作温度:-25℃~+85℃;; LCSC Part Name: Type-C 母 卧贴; Supplier Part: C2765186; Manufacturer: SHOU HAN(首韩); Supplier Footprint: SMD; JLCPCB Part Class: 扩展库; Datasheet: https://atta.szlcsc.com/upload/public/pdf/source/20250506/FFB74EDFDFA0AC372CE4A8E4F739CCEF.pdf; Supplier: LCSC; Connector Type: Type-C; Protocol Standard: USB 3.1; Gender: 母; Mounting Type: 卧贴; Number of Contacts: 16P; Number of Ports: 1; Current Rating-Power: 3A; Voltage Rating: 5V; Connect-Disconnect Life: 5千次; Detection color: 黑色; Operating Temperature: -25℃~+85℃
X15 = X32258MSB4SI: 晶振类型:贴片晶振;频率:8MHz;常温频差:±10ppm;负载电容:20pF;频率稳定度:±20ppm;; LCSC Part Name: 8MHz ±10ppm 20pF; Supplier Part: C2682774; Manufacturer: YXC(扬兴晶振); Supplier Footprint: SMD3225-4P; JLCPCB Part Class: 扩展库; Datasheet: https://atta.szlcsc.com/upload/public/pdf/source/20240329/19D5F850207469550BEB00D7DFEDBC7A.pdf; Supplier: LCSC; Type: 贴片晶振; Normal temperature Frequency Tolerance: ±10ppm; Load Capacitance: 20pF; Frequency Stability: ±20ppm; Operating Temperature: -40℃~+85℃

## Nets
3.3V: C62.1 C63.1 C301.2 C303.2 C304.2 C407.2 C415.2 CN3.2 HALL2.5 POWER2.2(+) R382.1 R444.2 R450.2 R451.2 R452.2 R456.1 R460.3 R482.2 R495.1 R496.2 R497.2 SIGNAL2.2(+) SPI2.1 U88.2(VOUT(TAB)) U134.1(VBAT) U134.16(VDD) U134.29(VDDA) U134.32(VDD) U134.48(VDD) U134.64(VDD) U135.8(VCC) U140.1 U148.1 U149.1
5V: C61.1 C269.1 C397.1 C443.1 C444.1 C445.1 L2.2 Q69.3(D) R413.1 R492.1 U88.3(VIN) U109.3(VCC) U132.3(VIN) USB1.2(VBUS) USB1.11(VBUS)
12V: C346.1 C347.2 C383.2 C384.2 C421.1 C422.1 C423.1 D51.1(A) D52.1(A) D53.1(A) L10.2 R433.2 U147.4(EN) U147.5(VIN) U150.1(VCC) U151.1(VCC) U152.1(VCC)
A3.3V: C316.2 C317.2 C398.1 C441.2 C442.2 R483.1 U132.2(VOUT(TAB)) U134.28(VREF+) U137.5(V+) U144.5(V+) U145.5(V+) U146.5(V+)
AGND: C316.1 C317.1 C397.2 C398.2 C417.1 C430.1 C431.1 C432.1 C441.1 C442.1 R423.1 R484.2 U132.1(ADJ(GND)) U134.27(VSSA) U137.2(GND) U144.2(GND) U145.2(GND) U146.2(GND)
GND: C61.2 C62.2 C63.2 C269.2 C296.1 C297.1 C299.1 C300.1 C301.1 C303.1 C304.1 C346.2 C347.1 C379.1 C383.1 C384.1 C390.1 C393.1 C394.1 C395.1 C396.1 C406.1 C407.1 C414.1 C415.1 C421.2 C422.2 C423.2 C440.1 C443.2 C444.2 C445.2 CN3.3 CN3.4 CN4.3 CN4.4 CN4.5 GPIO.4 HALL2.1 HALL2.6 HALL2.7 KEY1.3 KEY2.3 KEY3.3 KEY4.3 R381.1 R414.2 R420.2 R422.1 R423.2 R431.1 R432.1 R434.1 R457.2 R458.2 R459.1 R460.1 R481.1 R491.2 SPI2.6 SPI2.7 SPI2.8 SW1.3 U88.1(ADJ(GND)) U109.2(GND) U109.8(S) U122.7(GND) U122.9(GND) U134.15(VSS) U134.31(VSS) U134.47(VSS) U134.63(VSS) U135.1(A0) U135.2(A1) U135.3(A2) U135.4(VSS) U135.7(#WC) U139.5(RS) U139.12(LEDA) U140.4 U140.5 U140.6 U147.2(GND) U148.4 U148.5 U148.6 U149.4 U149.5 U149.6 U150.4(GND) U151.4(GND) U152.4(GND) USB1.1(GND) USB1.12(GND) USB1.13(SHELL) USB1.14(SHELL) X15.2(GND) X15.4(GND)
PGND: C435.2 C436.2 C437.2 C438.2 C439.2 C446.1 C447.1 D66.1 D67.1 R422.2 R425.1 R428.1 R429.1 R459.2 R503.2 R508.2 R513.2 U83.1 U84.1 U85.1 U126.1 U126.2 U126.3 U126.4
VBUS: C390.2 C435.1 C436.1 C437.1 C438.1 C439.1 C440.2 C446.2 C447.2 D66.2 D67.2 Q63.5(D) Q63.6(D) Q63.7(D) Q63.8(D) Q65.5(D) Q65.6(D) Q65.7(D) Q65.8(D) Q67.5(D) Q67.6(D) Q67.7(D) Q67.8(D) R430.2 U122.2(VIN) U125.1 U125.2 U125.3 U125.4
VDD: C424.2 C425.2 U139.4(SCL)
ADC_IN: C396.2 R461.2 U134.33(PB11)
BUTTON1: C395.2 KEY1.2 R452.1 U134.44(PA10)
BUTTON2: C394.2 KEY2.2 R451.1 U134.41(PC9)
BUTTON3: C393.2 KEY3.2 R450.1 U134.40(PC8)
BUTTON4: C414.2 KEY4.2 R482.1 U134.39(PC7)
CAN_H: CN4.1 R378.1 U109.6(CANL)
CAN_L: CN4.2 R378.2 U109.7(CANH)
DAC_OUT: GPIO.1 U134.19(PA5)
EEP_SCL: R497.1 U134.43(PA9) U135.6(SCL)
EEP_SDA: R496.1 U134.42(PA8) U135.5(SDA)
FB: R433.1 R434.2 U122.5(FB)
FDCAN_RX: R481.2 U109.4(RXD) U134.61(PB8-BOOT0)
FDCAN_TX: U109.1(TXD) U134.62(PB9)
GPIO1: GPIO.3 U134.52(PC10)
GPIO2: GPIO.2 U134.53(PC11)
HA: R455.2 U134.18(PA4)
HB: R454.2 U134.20(PA6)
HO1: D46.1(C) R222.1 U150.7(HO)
HO2: D43.1(C) R220.1 U152.7(HO)
HO3: D49.1(C) R224.1 U151.7(HO)
HZ: R453.2 U134.17(PA3)
I2C1_SCL: U134.51(PA15) U140.2
I2C1_SDA: U134.60(PB7) U140.3
IBUS: U134.11(PC3)
IREF: R494.2 U139.6(RESET)
IU: C430.2 R505.1 U134.12(PA0)
IV: C432.2 R515.1 U134.13(PA1)
IW: C431.2 R510.1 U134.14(PA2)
LED: R421.2 U134.59(PB6)
LO1: D47.1(C) R221.1 U150.5(LO)
LO2: D44.1(C) R219.1 U152.5(LO)
LO3: D50.1(C) R223.1 U151.5(LO)
NRST: C300.2 R444.1 SW1.2 U134.7(PG10-NRST)
NTC1: C299.2 R381.2 R382.2 U134.21(PA7)
NTC2: C406.2 CN3.1 R491.1 U134.26(PB2)
OLED_CS: U134.38(PC6) U139.7(CS)
OLED_DC: U134.36(PB14) U139.9(NC)
OLED_GPIO: Q70.1(G) R493.2
OLED_RES: R495.2 U139.8(GND)
OLED_SCK: U134.35(PB13) U139.10(VDD)
OLED_SDA: U134.37(PB15) U139.11(LEDK)
OSC_IN: C296.2 U134.5(PF0-OSC_IN) X15.1
OSC_OUT: C297.2 U134.6(PF1-OSC_OUT) X15.3
PWM1: U134.8(PC0) U150.2(HIN)
PWM1N: U134.2(PC13) U150.3(LIN)
PWM2: U134.9(PC1) U152.2(HIN)
PWM2N: U134.24(PB0) U152.3(LIN)
PWM3: U134.10(PC2) U151.2(HIN)
PWM3N: U134.25(PB1) U151.3(LIN)
SPI_CS: SPI2.2 U134.55(PD2)
SPI_MISO: SPI2.4 U134.57(PB4)
SPI_MOSI: SPI2.5 U134.58(PB5)
SPI_SCK: SPI2.3 U134.56(PB3)
SWCLK: U134.50(PA14) U148.3
SWDIO: U134.49(PA13) U148.2
U: C420.2 Q65.1(S) Q65.2(S) Q65.3(S) Q66.5(D) Q66.6(D) Q66.7(D) Q66.8(D) R424.1 U142.1 U142.2 U142.3 U142.4 U150.6(VS)
U_INP: Q66.1(S) Q66.2(S) Q66.3(S) R504.2 U84.2
USART_RX: U134.23(PC5) U149.2
USART_TX: U134.22(PC4) U149.3
USB_DM: U134.45(PA11) USB1.5(DN2) USB1.7(DN1)
USB_DP: R456.2 U134.46(PA12) USB1.6(DP1) USB1.8(DP2)
V: C418.2 Q63.1(S) Q63.2(S) Q63.3(S) Q64.5(D) Q64.6(D) Q64.7(D) Q64.8(D) R426.1 U152.6(VS) V2.1 V2.2 V2.3 V2.4
V_INP: Q64.1(S) Q64.2(S) Q64.3(S) R514.2 U83.2
VB1: C420.1 D53.2(K) U150.8(VB)
VB2: C418.1 D51.2(K) U152.8(VB)
VB3: C419.1 D52.2(K) U151.8(VB)
VCOM: C426.2 U139.3(SDA)
VPP: C427.2 C428.2 Q69.2(S) U139.2(NC)
VREF: R506.1 R511.1 R516.1 U137.3(-) U137.4(OUT)
VS3: C419.2 Q67.1(S) Q67.2(S) Q67.3(S) Q68.5(D) Q68.6(D) Q68.7(D) Q68.8(D) R427.1 U151.6(VS) W2.1 W2.2 W2.3 W2.4
W_INP: Q68.1(S) Q68.2(S) Q68.3(S) R509.2 U85.2
$1N9085: C345.2 U147.1(BST)
$1N9145: C380.1 L10.1 U122.8(SW)
$1N9147: C379.2 U122.6(VCC)
$1N9157: R430.1 R431.2 U122.3(EN)
$1N9158: R432.2 U122.4(RT)
$1N9242: D46.2(A) Q65.4(G) R222.2 R424.2
$1N9243: D47.2(A) Q66.4(G) R221.2 R425.2
$1N9259: D43.2(A) Q63.4(G) R220.2 R426.2
$1N9267: D44.2(A) Q64.4(G) R219.2 R428.2
$1N9279: D50.2(A) Q68.4(G) R223.2 R429.2
$1N9280: D49.2(A) Q67.4(G) R224.2 R427.2
$1N9505: C380.2 U122.1(BOOT)
$1N9531: C426.1 C427.1 C428.1 R494.1
$1N9558: C417.2 R483.2 R484.1 U137.1(+)
$1N24102: R413.2 R414.1 U147.3(FB)
$1N24243: C345.1 L2.1 U147.6(SW)
Net-(C424-1): C424.1 C425.1 Q70.2(S) R493.1
Net-(HALL2-2): HALL2.2 R453.1
Net-(HALL2-3): HALL2.3 R454.1
Net-(HALL2-4): HALL2.4 R455.1
Net-(POWER2-1): POWER2.1(-) R420.1
Net-(Q69-1): Q69.1(G) Q70.3(D) R492.2
Net-(R421-1): R421.1 SIGNAL2.1(-)
Net-(R457-1): R457.1 USB1.10(CC2)
Net-(R458-1): R458.1 USB1.4(CC1)
Net-(R460-2): R460.2 R461.1
Net-(R502-1): R502.1 R505.2 U144.4(OUT)
Net-(R502-2): R502.2 R504.1 U144.3(-)
Net-(R503-1): R503.1 R506.2 U144.1(+)
Net-(R507-1): R507.1 R510.2 U145.4(OUT)
Net-(R507-2): R507.2 R509.1 U145.3(-)
Net-(R508-1): R508.1 R511.2 U145.1(+)
Net-(R512-1): R512.1 R515.2 U146.4(OUT)
Net-(R512-2): R512.2 R514.1 U146.3(-)
Net-(R513-1): R513.1 R516.2 U146.1(+)

Not connected (* = marked no-connect by the designer): KEY1 1 4; KEY2 1 4; KEY3 1 4; KEY4 1 4; SW1 1 4; U109 5(VREF); U134 3(PC14-OSC32_IN) 4(PC15-OSC32_OUT) 30(PB10) 34(PB12) 54(PC12); U139 1(NC) 13(GND); USB1 3(SBU2) 9(SBU1)

## Notes on the sheet
- 复位电路
- 电源供电电路
- 按键电路
- 温度采样
- OLED驱动电路
- 电压采集电路
- 三相逆变电路
- 相电流采集电路
